# EasyEDA Pro project 蓝桥杯14届国赛.eprj, board PCB (continued)
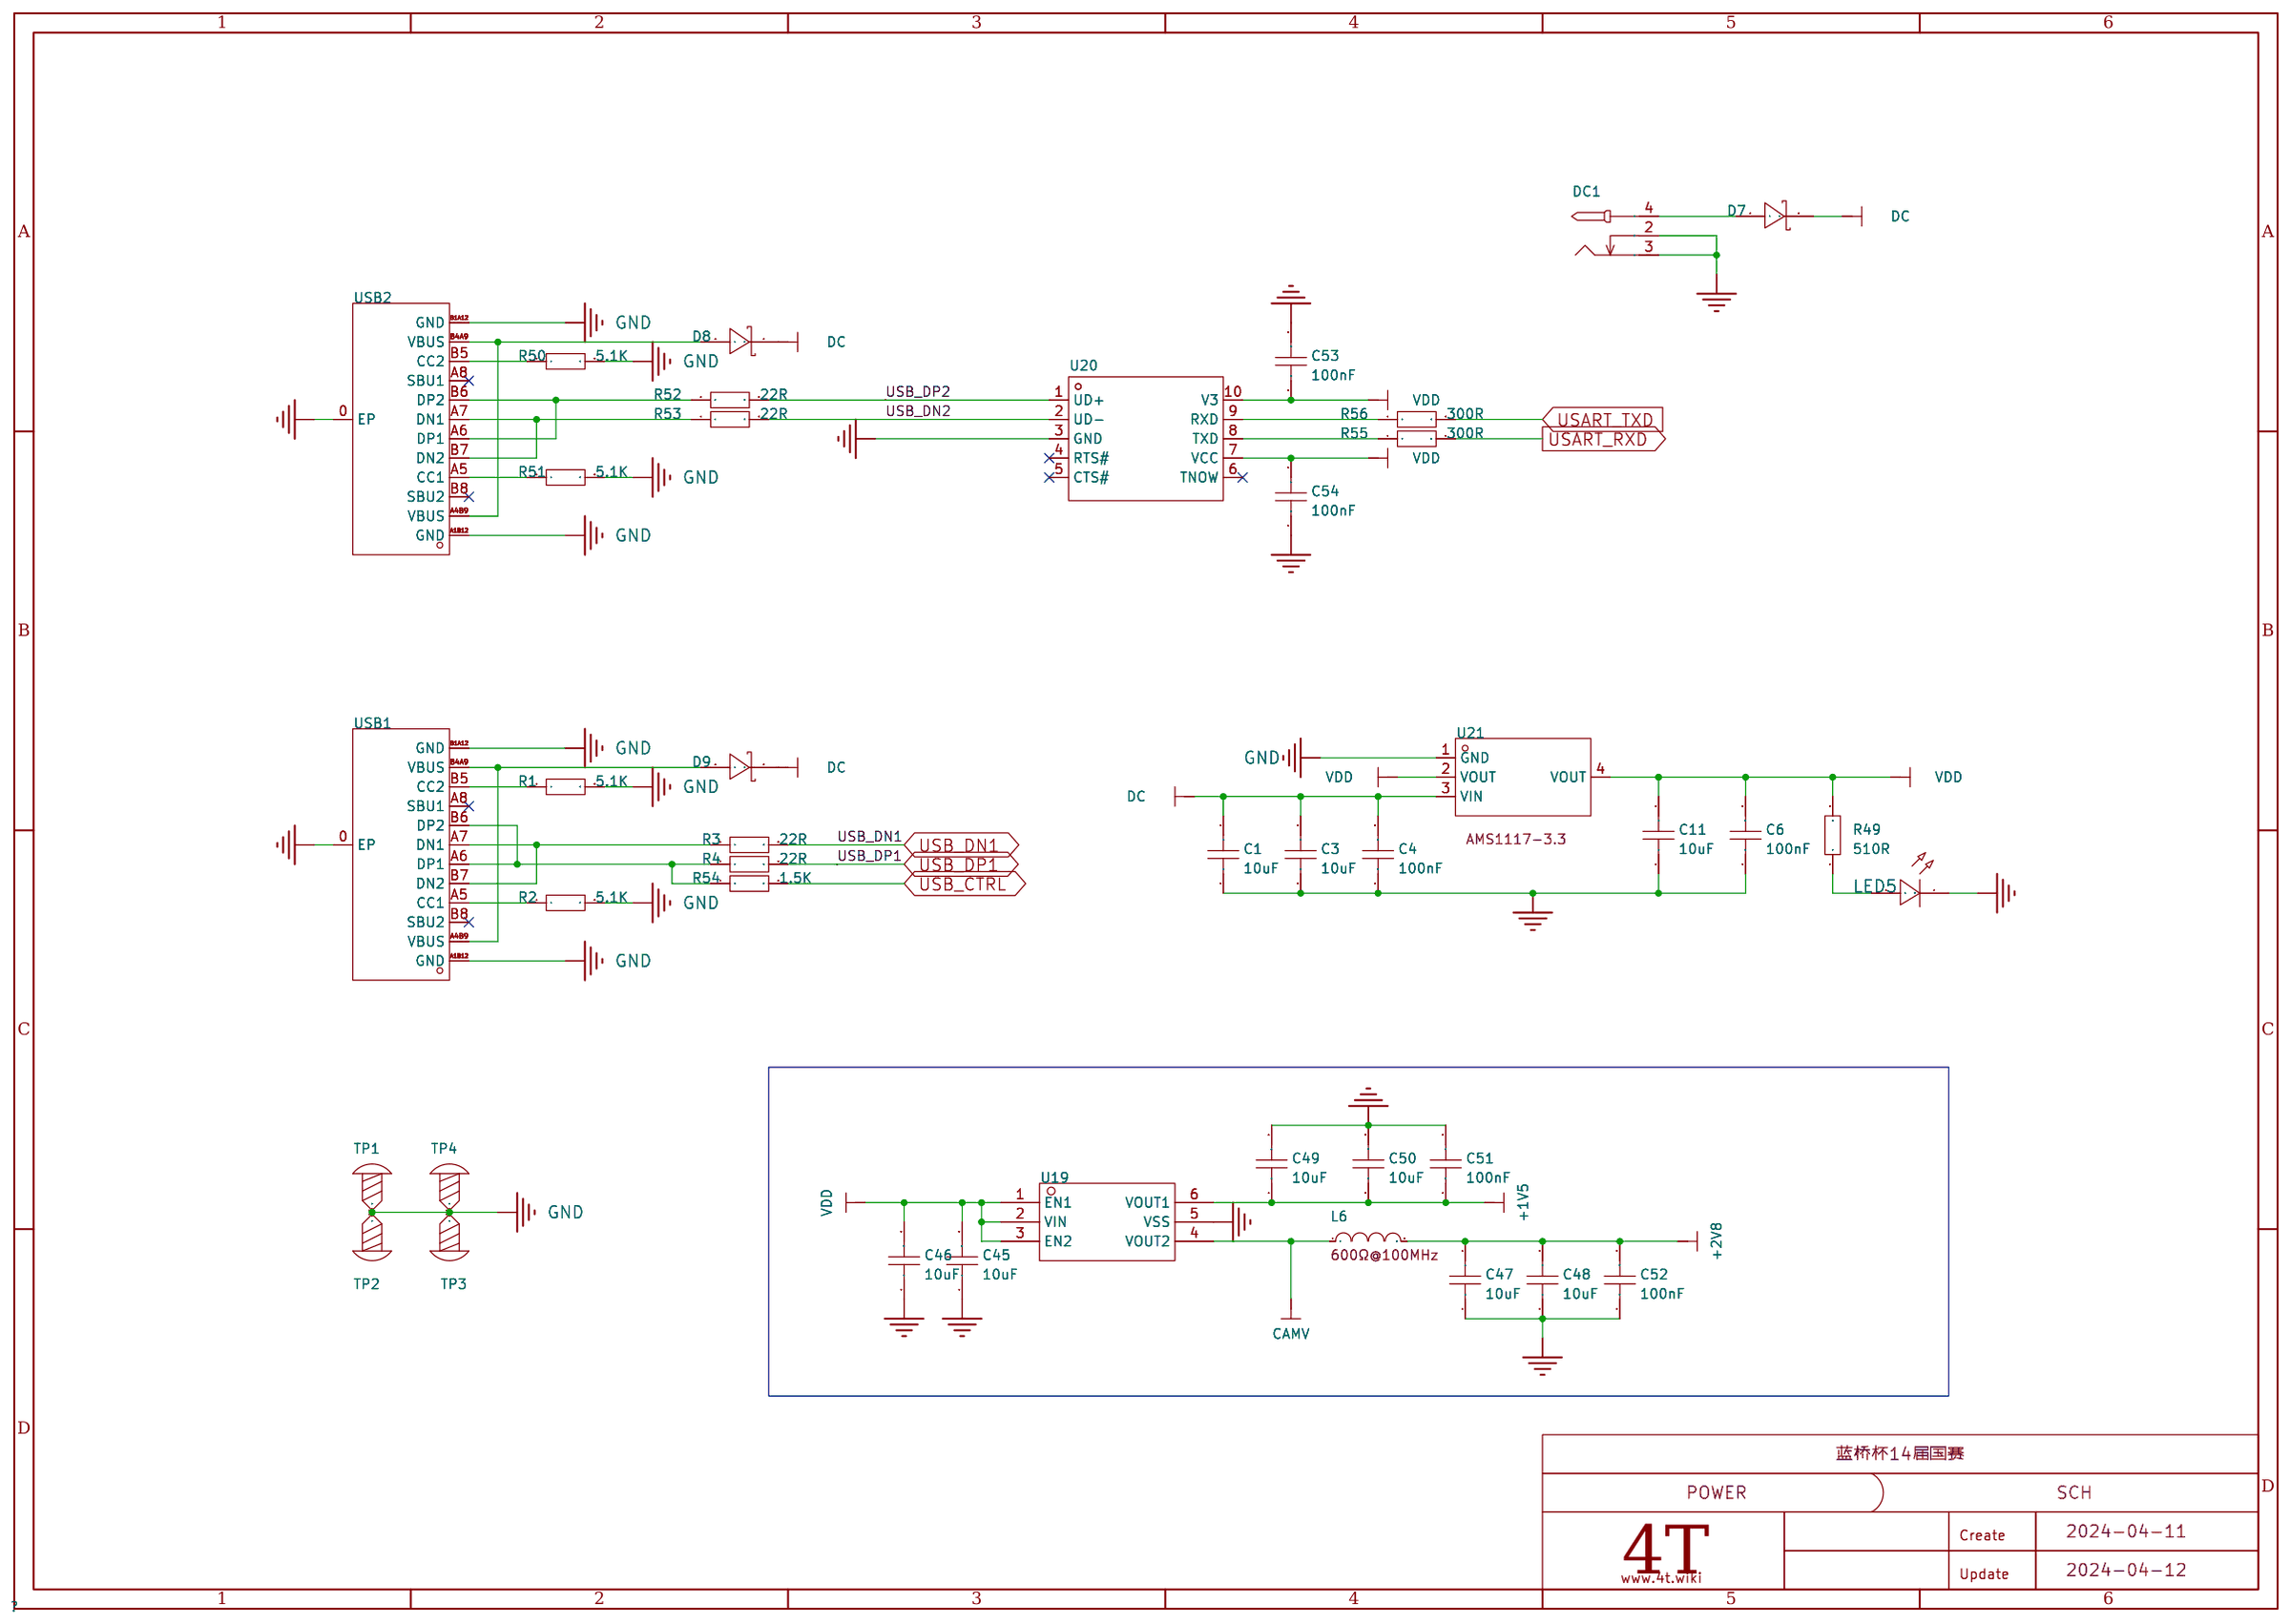
[diagram p0: POWER]
## Routing (per net, layer and track width the routed paths; a pad name or vN(x,y) marks a point on that pad's centre or on a via; arc(x,y) is an arc through that point) (continued)
  Top Layer w1.219: 22.73,24 v1(22.73,23.5) 22.73,20.74
  Bottom Layer w0.203: v1(46.35,5.33) 46.35,5.33 46.35,4.57 46.61,4.32 v1(49.78,4.32)
  Bottom Layer w0.61: v1(34.04,18.38) v1(34.91,18.38) v1(35.81,18.38) 37.48,18.38 v1(37.85,18.02) ; v1(37.85,15.88) 37.85,15 v1(37.86,14.99) ; v1(45.72,23.11) v1(44.83,23.11) v1(43.99,23.11) 43.94,23.06 v1(43.94,22.1) v1(44.88,22.1) v1(45.72,22.1) v1(45.72,21.21) v1(45.72,20.32) v1(45.72,19.43) v1(45.72,18.6) v1(45.72,17.59) v1(45.72,16.58) ; v1(44.04,26.03) v1(42.91,26.03) v1(41.77,26.03) v1(40.64,26.03) 40.26,26.03 v1(39.62,25.4) ; v1(36.96,25.4) v1(36.96,26.5) 36.96,27.52 v1(36.54,27.94) v1(35.65,27.94) v1(34.79,27.94) 34.16,27.94 v1(34.04,27.81) v1(34.04,27.05) v1(34.04,26.03) v1(33.15,26.03) v1(32.07,26.03) v1(31.15,26.03) v1(31.15,25.17) v1(31.15,24.3) v1(31.15,23.39) v1(31.15,22.37) 31.15,20.98 v1(31.12,20.95) v1(32.26,20.95) v1(33.15,20.95) 33.66,20.95 34.04,20.57 v1(34.04,20.05) v1(34.04,19.19)
  vias: v1(22.73,24.26) v1(36.96,18.42)
VDD: length 284.7
  Top Layer w0.203: 54,31.2 56.05,31.2 56.39,30.86 56.39,29.97 56.64,29.72 C38.1 ; C31.1 59.22,37.7 U17.32 ; U20.10 16.15,50.84 16.26,50.94 ; U14.20 53.63,46.38 C39.1 ; 39.38,30.7 39.37,30.72 ; 42.5,30.2 40.16,30.2 39.35,31 C30.1 ; 44.5,39.7 44.45,39.75 C29.1 ; C53.1 18.65,50.8 17.78,50.8 17.65,50.67 U20.7
  Top Layer w0.61: 39.37,30.72 39.37,30.97 39.35,30.99 39.24,30.88 39.24,30.21 38.88,29.84 32.89,29.84 v1(31.91,28.86) ; 59.18,46.36 56.15,46.36 56.13,46.34 C39.1 ; 59.54,46.36 63.52,46.36 R18.1 ; 59.54,46.36 60.59,45.3 C32.1 60.47,39.24 C31.1 v1(60.47,35) R15.1 ; 59.54,46.36 59.36,46.53 59.62,46.8 CN5.1 59.56,54.76 59.56,55.88 59.31,56.13 47.62,56.13 47.13,55.64 R28.2 v1(47.13,50.18) 47.13,48.89 ; R9.1 64.28,9.76 64.13,9.91 R44.2 ; U13.7 37.97,49.53 ; 37.97,49.53 37.91,49.53 ; 37.97,49.53 37.97,50.67 38.1,50.8 U13.8 ; 37.97,49.53 37.97,49.12 37.85,49 37.85,48.39 37.72,48.26 34.42,48.26 ; C29.1 42.91,42.43 42.67,42.67 42.67,44.32 42.42,44.58 v1(42.05,44.58) 40.28,44.58 R48.1 ; 30.1,44.55 30.1,52.58 29.59,53.09 29.59,54.67 CN11.9 ; 30.1,44.55 30.1,44.07 29.72,43.69 28.35,43.69 D5.2 28.32,44.7 28.19,44.83 25.27,44.83 24.89,45.21 24.89,47.88 24.13,48.64 19.05,48.64 18.92,48.77 18.92,50.67 ; 30.1,44.55 30.11,44.56 C35.2 ; 10.26,51.31 2.79,51.31 1.27,49.78 1.27,16.51 1.78,16 18.58,16 ; 10.26,51.31 10.67,51.72 H2.2 ; 10.26,51.31 18.43,51.31 C53.1 ; 18.58,16 18.58,23.53 21.97,26.92 29.97,26.92 v1(30.73,27.69) ; 18.58,16 23.24,16 23.5,15.75 U19.1 ; 34.42,48.26 31.67,48.26 U13.3 ; 34.42,48.26 34.54,48.13 R46.1 ; C38.1 v1(60.47,28.32) 60.45,28.31 60.45,26.8 60.83,26.42 62.99,26.42 63.25,26.16 63.25,19.43 63.75,18.92 R12.1
  Bottom Layer w0.61: v1(42.05,44.58) 44.45,44.58 47.13,47.26 v1(47.13,50.18) ; v1(60.47,35) v1(60.47,28.32) ; v1(30.73,27.69) v1(31.91,28.86)
VDDA: length 21.4
  Top Layer w0.203: U17.13 50.5,26.59 50.93,26.16 v1(50.93,25.27) 50.93,23.99 50.8,23.86
  Top Layer w0.61: L4.2 54.99,16.51 54.61,16.89 v1(54.61,23.37)
  Bottom Layer w0.61: v1(54.61,23.37) 51.31,23.37 50.93,23.75 v1(50.93,25.27)
0: length 80.4
  Top Layer w0.305: Q1.2 73.74,15.49 75.69,15.49 75.95,15.24 75.95,13.72 76.33,13.33 80.26,13.33 80.9,12.7 81.41,12.7 81.9,12.21 C26.2 82.04,8.87 U4.3
  Top Layer w0.381: v1(75.18,29.21) 74.99,29.4 74.06,29.4 v1(73.13,28.47) 72.88,28.23 U5.3 71.88,30.08 R14.1 ; Q3.2 72.05,42.36 71.88,42.53 ; 71.88,16.49 71.99,16.38 v1(73.13,16.38) ; 71.88,16.49 U3.3 73.48,14.43 73.66,14.61 73.66,15.42 Q1.2 ; 71.88,16.49 R11.1 ; 71.88,56.08 71.88,58.15 R20.1 ; 71.88,56.08 v1(71.88,52.58) ; 71.88,56.08 72.12,56.33 Q4.2 ; 71.88,42.53 U6.3 71.88,40.13 v1(71.75,40) ; 71.88,42.53 71.88,44.18 R17.1 73.28,45.86 73.28,49.28 72.14,50.42 v1(71.88,50.42)
  Bottom Layer w0.381: v1(71.75,40) 71.75,34.16 72.01,33.91 74.8,33.91 75.18,33.53 v1(75.18,29.21) ; v1(73.13,28.47) v1(73.13,16.38) ; v1(71.88,50.42) v1(71.88,52.58)
C_CLK: length 43.9
  Top Layer w0.203: v1(59.06,33.53) 59.06,35.05 57.41,36.7 U17.30 ; v1(53.72,4.32) 53.72,6.23 FPC1.13
  Bottom Layer w0.203: v1(59.06,33.53) 59.44,33.15 59.44,5.08 58.67,4.32 v1(53.72,4.32)
C_HSYNC: length 36.6
  Top Layer w0.203: 54,36.2 57.02,36.2 58.29,34.92 v1(58.29,33.02) ; v1(55.63,8.13) 55.75,8 FPC1.9
  Bottom Layer w0.203: v1(55.63,8.13) 55.75,8 58.41,8 58.53,8.13 58.53,32.78 v1(58.29,33.02)
C_PCLK: length 35
  Top Layer w0.203: 49,39.7 49,37.23 v1(49.53,36.7) ; FPC1.17 51.75,8.95 52.07,9.27 v1(52.07,26.16)
  Bottom Layer w0.203: v1(49.53,36.7) 52.23,34 52.23,26.33 v1(52.07,26.16)
C_PWDN: length 35.6
  Top Layer w0.203: R45.1 59.38,13.21 v1(57.4,13.21) 56.39,13.21 56.25,13.07 FPC1.8 ; v1(57.53,33.66) 57.53,34.8 56.63,35.7 U17.28
  Bottom Layer w0.203: v1(57.4,13.21) 57.53,13.33 v1(57.53,33.66)
C_RST: length 34.1
  Top Layer w0.203: U17.26 55.6,34.7 v1(55.88,34.42) ; R44.1 v1(57.91,9.91) 57.4,9.91 57.25,9.75 FPC1.6
  Bottom Layer w0.203: v1(57.91,9.91) 56.13,9.91 55.88,10.16 v1(55.88,34.42)
C_VSYNC: length 31.5
  Top Layer w0.203: 54,35.2 56.24,35.2 56.77,34.67 v1(56.77,34.16) ; FPC1.7 56.77,6.28 56.77,10.03 56.9,10.16 v1(56.9,12.06)
  Bottom Layer w0.203: v1(56.9,12.06) 56.77,12.19 v1(56.77,34.16)
CAMV: length 3.4
  Top Layer w0.305: U19.4 26.89,12.73 27.05,12.57 27.05,11.56 27.18,11.43 28.13,11.43 L6.1
CIN_1: length 3.9
  Top Layer w0.203: U14.6 53.63,51.85 53.85,52.07 54.36,52.07 54.62,52.34 CN5.5
CIN_2: length 3.8
  Top Layer w0.203: U14.8 52.83,53.09 52.71,53.21 52.2,53.21 52.12,53.28 CN5.7
CIN_3: length 5.1
  Top Layer w0.203: CN5.9 49.62,53.25 49.78,53.09 50.8,53.09 51.44,52.45 51.91,52.45 52.03,52.32 U14.10
CIN_4: length 5.4
  Top Layer w0.203: U14.5 55.7,50.88 55.88,51.05 CN5.4
COUT_1: length 3.3
  Top Layer w0.203: U14.7 53.23,54.56 CN5.6
COUT_2: length 4.2
  Top Layer w0.203: CN5.8 50.88,53.65 51.69,52.83 52.31,52.83 52.43,52.7 U14.9
COUT_3: length 6.2
  Top Layer w0.203: CN5.10 48.38,53.22 48.9,52.7 50.55,52.7 50.93,52.32 50.93,51.05 51.1,50.88 U14.11
COUT_4: length 6.9
  Top Layer w0.203: CN5.3 57.12,50.78 56.83,50.48 U14.4
CS: length 27.9
  Top Layer w0.203: v1(35.18,50.55) 34.92,50.8 U13.1 ; 52,39.7 52,41.98 45.85,48.13 v1(45.85,48.39)
  Bottom Layer w0.203: v1(35.18,50.55) 35.18,48.39 35.38,48.18 45.64,48.18 v1(45.85,48.39)
D_DATA0: length 29
  Top Layer w0.203: FPC1.19 50.75,9.57 v1(50.42,9.91) ; v1(47.62,8.13) 47.37,8.38 47.37,9.14 47.75,9.53 47.75,23.75 48.01,24 48.01,28.19 U17.8
  Bottom Layer w0.203: v1(47.62,8.13) 47.37,8.38 47.37,9.65 47.62,9.91 v1(50.42,9.91)
D_DATA1: length 23.6
  Top Layer w0.203: U17.9 48.51,28.18 48.51,23.75 48.13,23.37 v1(48.13,8.89) ; v1(49.53,8.89) 49.53,8.76 49.75,8.54 FPC1.21
  Bottom Layer w0.203: v1(48.13,8.89) v1(49.53,8.89)
D_DATA2: length 22.2
  Top Layer w0.203: FPC1.22 49.25,7.77 48.8,8.23 48.8,23.4 49,23.6 U17.10
D_DATA3: length 22.2
  Top Layer w0.203: FPC1.20 50.25,9.06 49.53,9.78 49.53,28.17 U17.11
D_DATA4: length 37.1
  Top Layer w0.203: v1(50.8,10.79) 51.25,10.34 FPC1.18 ; U17.24 53.96,33.66 51.25,33.66 51.12,33.53 v1(51.12,32.8)
  Bottom Layer w0.203: v1(50.8,10.79) 50.8,18.67 50.55,18.92 47.32,18.92 47.12,19.13 47.12,24.77 47.5,25.15 48.9,25.15 49.15,25.4 49.15,30.28 49.62,30.75 50.92,30.75 51.12,30.95 v1(51.12,32.8)
D_DATA5: length 39.4
  Top Layer w0.203: v1(51.05,34.29) 51.15,34.2 54,34.2 ; v1(52.45,7.87) 52.25,7.67 FPC1.16
  Bottom Layer w0.203: v1(52.45,7.87) 51.82,7.87 51.56,8.13 51.56,18.67 50.93,19.3 47.75,19.3 47.5,19.56 47.5,24.56 47.7,24.77 49.05,24.77 49.53,25.24 49.53,30.12 49.78,30.37 51.57,30.37 51.8,30.59 51.8,33.67 51.18,34.29 v1(51.05,34.29)
D_DATA6: length 35.5
  Top Layer w0.203: v1(50.8,37.85) 50,38.65 50,39.7 ; v1(52.71,24.64) 52.71,8.89 53.21,8.38 53.21,6.3 FPC1.14
  Bottom Layer w0.203: v1(50.8,37.85) 53.59,35.05 53.59,25.91 52.71,25.02 v1(52.71,24.64)
D_DATA7: length 35.6
  Top Layer w0.203: 49.5,39.7 49.5,37.88 v1(49.78,37.59) ; v1(52.86,26.54) 52.86,25.63 53.47,25.02 53.47,9.22 53.67,9.02 53.97,9.02 54.23,8.76 54.23,6.28 FPC1.12
  Bottom Layer w0.203: v1(52.86,26.54) 52.86,34.52 v1(49.78,37.59)
DC: length 76.8
  Top Layer w0.914: C24.2 69.47,1.54 69.47,2.92 69.09,3.3 ; C25.2 72.66,2.91 72.26,3.3 ; C4.2 20.69,1.93 21.6,1.02 37.87,1.02 ; 37.87,1.02 64.26,1.02 64.39,1.14 64.39,3.05 64.64,3.3 69.09,3.3 ; 37.87,1.02 38.61,1.75 38.61,2.29 38.23,2.67 36.41,2.67 U21.3 ; 69.09,3.3 72.26,3.3 ; 72.26,3.3 84.2,3.3 84.58,3.68 U4.2
  vias: v1(16.64,37.34) v1(16.64,36.45) v1(16.64,35.56) v1(17.64,35.56) v1(17.65,37.34) v1(17.65,36.45) v1(19.94,14.61) v1(19.93,13.65) v1(20.64,14.61) v1(20.64,13.65) v1(21.34,14.61) v1(21.34,13.65)
IO_CTRL1: length 43.1
  Top Layer w0.203: U3.2 71.88,6.6 71.63,6.86 65.66,6.86 65.28,7.24 65.28,19.81 64.9,20.19 64.39,20.19 63.88,20.7 63.88,30.86 63.5,31.24 56.64,31.24 56.19,31.7 U17.20
IO_CTRL2: length 30.3
  Top Layer w0.203: U5.2 71.88,20.19 71.5,20.57 64.64,20.57 64.26,20.95 64.26,31.5 64.13,31.62 57.34,31.62 56.77,32.2 54,32.2
IO_CTRL3: length 19.6
  Top Layer w0.203: U6.2 71.88,31.75 71.63,31.5 67.69,31.5 67.18,32 57.5,32 56.81,32.7 U17.22
IO_CTRL4: length 32
  Top Layer w0.203: 71.88,46.66 71.88,45.47 71.75,45.34 69.09,45.34 68.96,45.21 64.77,45.21 64.52,44.96 64.52,32.64 64.26,32.39 57.78,32.39 57,33.17 54,33.17
LCD_BLK: length 74.4
  Top Layer w0.203: v1(49.4,32.13) 51.56,32.13 52.45,31.24 52.45,30.48 52.73,30.2 54,30.2 ; v1(32.38,51.69) 32.12,51.95 CN11.7
  Bottom Layer w0.203: v1(49.4,32.13) 32.51,32.13 28.96,28.58 20.83,28.58 20.37,29.03 20.37,51.49 20.83,51.94 32.13,51.94 v1(32.38,51.69)
LCD_CD: length 77.1
  Top Layer w0.203: U17.15 51.5,30.29 51.05,30.73 v1(45.97,30.73) ; CN11.5 34.8,54.53 v1(34.8,52.58)
  Bottom Layer w0.203: v1(34.8,52.58) 34.67,52.7 20.19,52.7 19.61,52.12 19.61,28.17 19.97,27.81 29.34,27.81 32.26,30.73 v1(45.97,30.73)
LCD_CS: length 78
  Top Layer w0.203: v1(46.48,29.97) 46.86,30.35 50.42,30.35 51,29.77 U17.14 ; v1(35.94,53.21) 35.94,54.63 CN11.4
  Bottom Layer w0.203: v1(35.94,53.21) 20.07,53.21 19.23,52.38 19.23,28.02 19.81,27.43 29.5,27.43 32.03,29.97 v1(46.48,29.97)
LCD_RST: length 76.2
  Top Layer w0.203: CN11.6 33.38,52.22 v1(33.53,52.07) ; U17.16 52,30.81 51.31,31.5 v1(45.09,31.5)
  Bottom Layer w0.203: v1(33.53,52.07) 33.27,52.32 20.45,52.32 19.99,51.87 19.99,28.65 20.45,28.19 29.11,28.19 32.42,31.5 v1(45.09,31.5)
LOAD: length 129.7
  Top Layer w0.305: U4.4 79.5,8.62 C26.1 79.9,12.56 79.63,12.83 74.7,12.83 D1.1
  Top Layer w0.381: D1.1 74.29,12.46 R10.2 v1(66.42,11.18) ; R19.2 65.91,52.32 66.68,51.56 74.78,51.56 D4.1 ; D4.1 74.8,54.23 75.06,54.48 K4.1 ; D4.1 v1(74.8,49.91) ; v1(66.42,23.75) 66.42,26.05 R13.2 74.16,26.43 D2.1 80.04,27.08 80.39,27.43 80.39,30.99 80.9,31.5 82.17,31.5 K2.1 ; v1(75.18,42.29) 75.18,40.67 v1(74.8,40.28) 73.38,38.86 67.2,38.86 R16.2
  Bottom Layer w0.381: v1(74.8,40.28) 74.8,36.7 75.18,36.32 80.52,36.32 82.3,34.54 82.3,31.88 K2.1 K1.1 ; v1(74.8,49.91) 76.2,49.91 76.33,49.78 76.33,42.67 75.95,42.29 v1(75.18,42.29) ; v1(66.42,11.18) v1(66.42,23.75) ; K4.1 K3.1
M_ALERT: length 28.1
  Top Layer w0.203: 42.5,34.2 42.53,34.16 48.26,34.16 52.45,38.35 52.45,42.07 48.13,46.39 48.13,49.53 48.39,49.78 49.78,49.78 49.89,49.68 U14.14
M_C: length 46.7
  Top Layer w0.203: v1(24.89,33.66) 25.02,33.78 29.5,33.78 29.84,34.13 29.84,38.35 29.97,38.48 v1(30.61,38.48) ; v1(41.66,38.48) 41.91,38.23 45.34,38.23 45.5,38.39 45.5,39.7 ; v1(26.03,50.8) 24.78,50.8 R39.2
  Bottom Layer w0.203: v1(26.03,50.8) 24.89,50.8 24.38,50.29 24.38,34.16 v1(24.89,33.66) ; v1(41.66,38.48) v1(30.61,38.48)
M_HX1: length 15.8
  Top Layer w0.254: U17.5 46.5,25.39 45.43,24.32 41.72,24.32 41.5,24.1 41.5,23.37 40.78,22.64 R27.1 40.65,20.9 40.36,20.61 40.36,17.95 39.85,17.44
M_HX2: length 15.8
  Top Layer w0.254: 43.95,17.44 42.8,18.58 42.8,22.49 R27.2 42.63,22.64 41.91,23.37 41.91,23.75 42.08,23.92 45.6,23.92 47,25.32 U17.6
M_LX1: length 16.7
  Top Layer w0.254: U17.3 45.5,26.07 44.7,25.27 40.51,25.27 38.86,23.62 35.52,23.62 35.43,23.71 C36.2 35.38,24.58 X1.2
M_LX2: length 17.5
  Top Layer w0.254: U17.4 46,25.93 44.83,24.77 40.64,24.77 38.86,22.99 35.52,22.99 35.43,22.9 C37.2 X1.1
M_RST#: length 22.9
  Top Layer w0.203: v1(50.16,29.72) 50.04,29.84 47.63,29.84 47.5,29.72 U17.7 ; C28.1 59.44,24 59.18,24.26 v1(54.99,24.26)
  Top Layer w0.305: R22.1 59.32,22.99 C28.1
  Bottom Layer w0.203: v1(54.99,24.26) 54.74,24 51.82,24 51.56,24.26 51.56,25.53 50.16,26.92 v1(50.16,29.72)
M_SCL: length 92.7
  Top Layer w0.203: 49.13,48.89 49.51,49.28 U14.15 ; v1(50.16,34.42) 50.04,34.42 48.82,33.2 42.5,33.2 ; 59.44,3.43 59.56,3.3 59.56,2.41 58.9,1.75 52.49,1.75 52.32,1.92 52.32,2.03 44.83,2.03 44.45,2.41 44.45,5.72 44.7,5.97 v1(45.59,5.97) ; R29.2 48.9,48.53 48.9,46.61 v1(50.8,44.7) ; v1(57.24,3.68) 57.24,4.92 v1(57.4,5.08) 57.66,5.08 57.78,5.21 57.78,6.23 FPC1.5
  Bottom Layer w0.203: v1(57.24,3.68) 57.28,3.68 57.44,3.52 59.34,3.52 v1(59.45,3.4) ; v1(50.8,44.7) 48.9,42.8 48.9,35.69 v1(50.16,34.42) 50.16,34.23 50.56,33.84 50.56,33.09 50.43,32.96 50.43,32.33 50.44,32.32 50.44,31.33 50.24,31.13 49.42,31.13 48.77,30.48 48.77,25.78 48.51,25.53 47.24,25.53 46.74,25.02 46.74,18.8 47.24,18.29 49.91,18.29 50.42,17.78 50.42,11.43 50.04,11.05 47.37,11.05 46.99,10.67 46.99,6.01 46.95,5.97 v1(45.59,5.97)
M_SDA: length 91.4
  Top Layer w0.203: 49.15,51.55 R28.1 ; 49.15,51.55 49.26,51.44 v1(50.29,51.44) ; 49.15,51.55 49.15,50.55 49.22,50.48 U14.12 ; v1(53.59,2.38) 58.4,2.38 58.76,2.73 58.76,6.25 FPC1.3 ; U17.59 49.08,32.7 49.62,33.24 v1(49.88,33.24)
  Bottom Layer w0.203: v1(50.29,51.44) 50.55,51.18 50.55,45.59 48.51,43.56 48.51,34.6 v1(49.88,33.24) 50.04,33.08 50.04,31.64 49.91,31.51 49.16,31.51 48.64,30.99 48.64,30.89 48.39,30.64 48.39,26.29 48.01,25.91 47.09,25.91 46.35,25.18 46.35,18.03 46.61,17.78 49.53,17.78 50.04,17.27 50.04,11.68 49.78,11.43 47.21,11.43 46.61,10.83 46.61,6.86 46.35,6.6 44.96,6.6 44.7,6.35 44.7,2.18 44.89,1.99 53.49,1.99 53.62,2.13 53.62,2.35 v1(53.59,2.38)
MISO: length 30.9
  Top Layer w0.203: v1(44.07,49.53) 43.94,49.53 43.94,48.86 51,41.81 51,39.7
  Top Layer w0.61: U13.2 31.67,49.53 37.08,49.53 37.12,49.57 CN11.3
  Bottom Layer w0.203: v1(44.07,49.53) 36.7,49.53
  vias: v1(36.83,49.53)
MOSI: length 30.3
  Top Layer w0.203: 50.5,39.7 50.5,41.77 45.28,46.99 42.29,46.99
  Top Layer w0.61: U13.5 39.17,46.99 42.29,46.99 43.2,47.9 43.2,52.4 42.24,53.37 40.87,53.37 40.51,53.72 40.51,55.88 40.26,56.13 38.61,56.13 38.38,55.9 CN11.2
OC1A: length 9.7
  Bottom Layer w0.381: K1.3 94.74,14.99 CN1.1
OC1B: length 8.4
  Bottom Layer w0.381: K1.4 89.41,13.97 93.85,9.53 CN1.2
OC2A: length 16
  Top Layer w0.381: CN2.1 94.39,25.55 83.21,25.55 82.42,24.77 K2.3
OC2B: length 17.8
  Top Layer w0.381: CN2.2 93.22,19.3 83.19,19.3 82.42,18.54 K2.4
OC3A: length 9.3
  Bottom Layer w0.381: K3.3 CN3.1
OC3B: length 8.3
  Bottom Layer w0.381: K3.4 89.28,36.7 93.34,32.64 CN3.2
OC4A: length 14.3
  Top Layer w0.381: K4.3 84.07,44.32 89.28,49.53 CN4.1
OC4B: length 16.5
  Top Layer w0.381: CN4.2 94.87,44.32 94.87,42.8 93.98,41.91 87.76,41.91 K4.4
S_RESET#: length 26.6
  Top Layer w0.203: v1(52.2,47.62) 52.2,42.86 52.83,42.23 52.83,38.2 48.33,33.7 U17.57 ; v1(54.86,47.88) 54.86,49.15 54.74,49.28 U14.1
  Bottom Layer w0.203: v1(54.86,47.88) 52.45,47.88 v1(52.2,47.62)
SCK: length 26
  Top Layer w0.203: 51.5,39.7 51.5,41.85 44.83,48.51 v1(44.83,48.89)
  Top Layer w0.61: U13.6 39.17,48.26 41.66,48.26 42.04,48.64 v1(42.04,48.89) 42.04,52.45 41.91,52.58 39.88,52.58 39.62,52.83 CN11.1
  Bottom Layer w0.203: v1(44.83,48.89) v1(42.04,48.89)
USART_RXD: length 46
  Top Layer w0.203: 47,39.7 v1(47,41.78) ; R55.2 23.5,42.29 23.37,42.16 21.46,42.16 20.95,41.66 20.95,35.05 21.34,34.67 27.94,34.67 28.57,35.31 v1(28.57,41.66)
  Bottom Layer w0.203: v1(28.57,41.66) 46.87,41.66 v1(47,41.78)
USART_TXD: length 45.2
  Top Layer w0.203: 47.5,39.7 47.5,41.02 ; 47.5,41.02 v1(47.75,41.28) ; R56.2 20.57,43.83 20.57,34.49 20.78,34.29 29.34,34.29 29.46,34.42 v1(29.46,41.02)
  Bottom Layer w0.203: v1(29.46,41.02) 47.5,41.02 v1(47.75,41.28)
USB_CTRL: length 52.7
  Top Layer w0.254: 48,39.7 48,38.57 47.62,38.2 v1(47.62,37.72) ; 28.19,29.84 28.19,29.46 27.94,29.21 22.42,29.21 18.96,25.75 13.46,25.75 R54.2
  Bottom Layer w0.254: v1(47.62,37.72) 47.62,37.21 47.12,36.71 45.2,36.71 44.45,37.47 44.45,39.37 44.2,39.62 28.45,39.62 27.89,39.06 27.89,30.72 28.19,30.42 v1(28.19,29.97)
USB_DN1: length 52.6
  Top Layer w0.254: R3.2 13.46,26.15 18.79,26.15 22.25,29.62 27.05,29.62 27.18,29.74 v1(27.18,29.97) ; 46.5,39.7 46.5,38.57 46.74,38.33 46.74,38.32 v1(46.74,37.72)
  Bottom Layer w0.254: v1(27.18,29.97) 27.18,30.42 27.48,30.72 27.48,31.35 27.21,31.61 27.21,32.87 27.48,33.14 27.48,34.39 27.23,34.65 26.72,34.65 26.47,34.9 26.47,35.92 26.72,36.17 27.23,36.17 27.48,36.43 27.48,39.23 28.28,40.03 44.36,40.03 44.86,39.54 44.86,37.63 45.37,37.12 46.48,37.12 46.74,37.37 v1(46.74,37.72)
USB_DN2: length 6.5
  Top Layer w0.254: U20.2 16.64,43.75 16.64,44.7 16.38,44.96 15.23,44.96 14.97,45.21 14.97,45.36 14.72,45.61 13.7,45.61 13.45,45.36 13.45,45.21 13.2,44.96 R53.2
USB_DP1: length 54.8
  Top Layer w0.203: v1(45.97,35.94) 45.97,39.67 46,39.7 ; v1(29.08,29.97) 28.96,29.97 28.96,29.21 28.55,28.8 22.83,28.8 19.37,25.34 14.29,25.34 14.1,25.15 14.1,21.84 13.94,21.68 R4.2
  Bottom Layer w0.203: v1(29.08,29.97) 29.08,38.73 29.57,39.22 43.97,39.22 44.04,39.14 44.04,37.24 45.21,36.07 45.97,36.07 v1(45.97,35.94)
USB_DP2: length 6.7
  Top Layer w0.254: U20.1 16.13,43.71 16.13,42.67 16,42.55 15.62,42.55 15.49,42.67 15.49,43.56 14.9,44.15 13.59,44.15 R52.2
$1N757: length 7.7
  Top Layer w0.203: USB1.B5 8.86,23.9 9.02,23.75 9.02,18.54 9.14,18.42 R1.1
$1N782: length 4.7
  Top Layer w0.203: 10.28,29.46 10.28,29.46 9.27,29.46 9.02,29.21 9.02,27.05 8.87,26.9 USB1.A5
$1N965: length 17.8
  Top Layer w0.305: 5.46,27.56 5.72,27.81 6.89,27.81 7.13,28.05 USB1.A4B9 ; 5.46,27.19 5.46,23.75 5.72,23.5 6.86,23.5 7.11,23.24 7.85,23.24 USB1.B4A9
  Top Layer w0.61: 9.03,32.88 9.01,32.89 5.72,32.89 5.46,32.64 5.46,27.19
$1N986: length 8
  Top Layer w0.203: USB1.B7 6.08,26.4 5.89,26.21 5.89,25.6 6.1,25.4 7.86,25.4 USB1.A7
  Top Layer w0.254: R3.1 10.28,26.55 10.29,26.54 10.15,26.4 USB1.B7
$1N5837: length 3.1
  Top Layer w0.203: 28.29,8.12 28.18,8.02 28.18,5.08
$1N6125: length 5.8
  Top Layer w0.203: 7.86,45.19 8.74,45.19 8.89,45.34 8.89,48.51 9.14,48.77 R51.1
$1N6128: length 4
  Top Layer w0.203: R50.1 9.14,40.39 8.89,40.64 8.89,42.04 8.74,42.19 7.86,42.19
$1N6129: length 18.1
  Top Layer w0.305: USB2.A4B9 7.13,46.34 6.9,46.1 6.22,46.1 5.97,45.85 5.97,42.16 6.22,41.91 6.76,41.91 7.14,41.54 USB2.B4A9
  Top Layer w0.61: D8.2 8.96,36.96 5.33,36.96 4.95,37.34 4.95,42.16 5.08,42.29 5.84,42.29 5.97,42.16
$1N6270: length 6.1
  Top Layer w0.203: 7.94,43.19 9.22,43.19 9.33,43.3 9.33,44.06 9.2,44.19 10.22,44.19 10.28,44.12 R52.1 ; 7.86,44.19 9.2,44.19
$1N6277: length 7.2
  Top Layer w0.203: 7.86,43.69 6.6,43.69 6.48,43.81 6.48,44.58 6.59,44.69 USB2.B7 10.22,44.69 10.28,44.76 R53.1
$1N6306: length 8.2
  Top Layer w0.254: USB1.B6 7.88,24.89 8.64,24.89 8.89,25.15 8.89,25.9 ; R4.1 R54.1 ; 8.89,25.9 USB1.A6 ; 8.89,25.9 10.03,25.9 10.29,25.65 10.29,24.73
$1N6538: length 8.1
  Top Layer w0.203: U20.8 17.15,46.98 17.27,46.86 23.24,46.86 23.5,46.61 R55.1
$1N6566: length 5.9
  Top Layer w0.203: R56.1 16.91,45.96 16.65,46.21 U20.9
$2N490: length 3.1
  Top Layer w0.381: U3.1 69.29,5.08 R9.2
$2N1169: length 17.7
  Top Layer w0.381: Q1.1 73.68,17 v1(74.29,16.38) ; R10.1 69.31,14.46 U3.4 69.74,14.83 R11.2 v1(67.94,16.64)
  Bottom Layer w0.381: v1(74.29,16.38) 74.55,16.13 74.55,15.24 74.42,15.11 68.07,15.11 67.94,15.24 v1(67.94,16.64)
$2N1323: length 34.7
  Top Layer w0.381: Q1.3 76.58,16.38 ; 76.58,16.38 79.76,16.38 80.01,16.64 80.01,24.99 81.13,26.11 87.45,26.11 88.14,26.8 K1.2 ; 76.58,16.38 76.71,16.26 v1(76.71,14.22) ; v1(76.58,11.81) 76.58,7.87 76.43,7.72 D1.2
  Bottom Layer w0.381: v1(76.71,14.22) 76.58,14.1 v1(76.58,11.81)
$2N1681: length 3.1
  Top Layer w0.381: R12.2 69.34,18.92 U5.1
$2N1686: length 17.1
  Top Layer w0.381: Q2.1 73.34,31.3 73.03,30.99 v1(73.03,30.35) ; 69.14,28.43 69.61,28.9 R14.2 v1(66.42,30.35) ; 69.14,28.43 R13.1 ; 69.14,28.43 U5.4
  Bottom Layer w0.381: v1(66.42,30.35) v1(73.03,30.35)
$2N1700: length 30.6
  Top Layer w0.381: D2.2 78.99,21.95 79.38,22.33 79.38,25.15 80.9,26.67 82.17,26.67 82.42,26.92 K2.2 83.95,29.21 84.33,29.59 84.33,33.27 84.07,33.53 80.01,33.53 79.76,33.27 79.76,30.61 79.5,30.35 Q2.3
$2N2005: length 7.1
  Top Layer w0.381: U6.1 68.8,33.4 v1(65.53,33.4) ; R15.2 v1(63.75,33.4)
  Bottom Layer w0.381: v1(63.75,33.4) v1(65.53,33.4)
$2N2010: length 16.5
  Top Layer w0.381: Q3.1 v1(75.06,44.26) ; R16.1 69.21,42.02 U6.4 69.74,42.55 R17.2 v1(67.56,44.32)
  Bottom Layer w0.381: v1(75.06,44.26) 74.99,44.32 v1(67.56,44.32)
$2N2024: length 25.1
  Top Layer w0.381: K3.2 86.36,50.17 84.2,50.17 77.34,43.31 Q3.3 76.07,43.16 76.07,35.43 75.79,35.15 D3.2
$2N2329: length 3.8
  Top Layer w0.381: R18.2 69.04,46.48 U7.1
$2N2334: length 16.3
  Top Layer w0.381: Q4.1 v1(75.18,58.23) ; v1(67.82,58.55) R20.2 69.49,56.23 69.12,55.86 R19.1
  Bottom Layer w0.381: v1(67.82,58.55) 72.52,58.55 72.77,58.29 75.12,58.29 v1(75.18,58.23)
$2N2348: length 24.8
  Top Layer w0.381: D4.2 75.92,46.46 81.41,51.94 K4.2 83.95,51.94 84.46,52.45 84.46,56.39 83.57,57.28 Q4.3
$3N4170: length 20.1
  Top Layer w0.254: H2.1 8.13,58.8 8.38,59.06 11.81,59.06 11.94,58.93 11.94,55.88 12.75,55.07 21.13,55.07 21.84,54.36 R38.1
$3N4171: length 13.2
  Top Layer w0.254: H2.4 15.88,57.53 15.88,55.88 16.26,55.5 24.51,55.5 24.64,55.37 R39.1
$3N4361: length 4.3
  Top Layer w0.203: 42.5,32.2 40.94,32.2 40.37,32.77 39.56,32.77 39.35,32.97 R21.2
$3N4426: length 44.4
  Top Layer w0.203: U17.1 44.5,27.1 44.32,26.92 41.91,26.92 41.53,27.31 41.53,28.83 41.1,29.26 33.32,29.26 31.88,27.81 31.5,27.81 30.61,28.7 30.61,35.18 31.24,35.81 32.13,35.81 ; 33.15,35.69 33.4,35.43
  Top Layer w0.914: v1(30.1,42.55) 30.1,41.78 31.75,40.13 31.75,36.19 32.13,35.81 33.02,35.81 33.15,35.69 33.15,35.04 C43.1
  Bottom Layer w0.914: v1(26.8,46.99) v1(27.45,46.99) v1(28.12,46.99) v1(28.79,46.99) 29.97,46.99 30.1,46.86 v1(30.1,42.55)
$3N5935: length 42.4
  Top Layer w0.203: v1(30.73,37.34) 30.61,37.34 30.23,36.96 30.23,33.27 29.84,32.89 v1(24.13,32.89) ; R38.2 21.84,49.66 21.97,49.53 v1(23.5,49.53) ; v1(40.77,37.34) 41.13,37.7 U17.49
  Bottom Layer w0.203: v1(40.77,37.34) v1(30.73,37.34) ; v1(23.5,49.53) 23.88,49.15 23.88,33.15 v1(24.13,32.89)
$3N8528: length 3.9
  Top Layer w0.203: 39.87,38.09 39.87,36.96 40.13,36.7 42.49,36.7 U17.51
$3N8530: length 7.1
  Top Layer w0.203: 37.08,38.09 37.21,37.96 37.21,36.45 37.46,36.2 42.5,36.2
$3N8532: length 10.8
  Top Layer w0.203: U17.53 34.03,35.7 33.91,35.81 33.91,37.96 33.9,37.97
$3N8599: length 2.7
  Top Layer w0.203: 33.9,40.17 34.54,40.81 R46.2
$3N8602: length 2.5
  Top Layer w0.203: R47.2 37.59,40.81 37.08,40.29
$3N8605: length 2.4
  Top Layer w0.203: R48.2 40.26,40.68 39.87,40.29
$3N13768: length 19.5
  Top Layer w0.203: FPC1.11 54.74,6.25 54.74,3.94 54.23,3.43 48.8,3.43 48.39,3.84 48.39,4.84 47.82,5.4 47.61,5.4 47.55,5.46 47.55,6.53 46.87,7.21 46.87,10.93
  Top Layer w0.305: 46.87,10.93 46.86,10.94 44.32,10.94
$3N13829: length 29.1
  Top Layer w0.203: FPC1.4 58.25,3.39 57.87,3.01 48.17,3.01 48.01,3.18 48.01,4.68 47.67,5.02 47.31,5.02 46.99,5.33 46.99,6.48 46.13,7.34 42.06,7.34 41.78,7.62 C56.1
  Top Layer w0.305: R58.1 C56.1

## Copper pours and planes (outline as drawn; the poured copper is in the pictures)
+1V5 on Top Layer: 24.89,17.65 32.76,17.65 32.76,14.22 24.89,14.22
+2V8 on Top Layer: 27.52,14.22 40.13,14.22 40.13,12.32 27.52,12.32
GND on Top Layer: -9.27,68.33 104.78,68.33 104.78,-3.94 -9.27,-3.94
GND on Bottom Layer: -8,62.86 103.63,62.86 103.63,-3.18 -8,-3.18
VDD on Top Layer: 60.58,20.83 64.9,20.83 64.9,9.02 60.58,9.02
VDD on Top Layer: 30.72,45.32 41.18,45.32 41.18,43.69 30.72,43.69
VDD on Top Layer: 22.61,15.24 43.94,15.24 43.94,1.91 22.61,1.91
DC on Top Layer: 19.37,12.95 21.84,12.95 21.84,1.14 19.37,1.14
DC on Top Layer: 12.52,38.23 15.24,38.23 15.24,31.5 12.52,31.5
DC on Top Layer: 13.72,38.23 18.67,38.23 18.67,35.18 13.72,35.18
DC on Top Layer: 19.43,14.99 21.84,14.99 21.84,12.31 19.43,12.31
DC on Bottom Layer: 16.19,38.23 21.84,38.23 21.84,13.21 16.19,13.21
$1N7582 on Top Layer: 11.81,13.97 17.53,13.97 17.53,9.53 11.81,9.53
$3N3779 on Top Layer: 21.34,44.32 27.31,44.32 27.31,35.05 21.34,35.05
$3N4426 on Top Layer: 25.56,47.5 29.34,47.5 29.34,45.34 25.56,45.34

Small or netless copper shapes (teardrops, artwork), in the pictures only: 474 on Top Layer, 113 on Bottom Layer

## Text on the board
Top Silkscreen Layer: VDD | GND | LOAD | 0 | DC | PA14 | PA13
